# EAGLE schematic Resistor_Resistor (EAGLE 8.3.0), part 36 of 43
## Nets (continued)
N$107: R19601.2 R19602.2 R19603.2 R19604.2 R19605.2 R19606.2 R19607.2 R19608.2 R19609.2 R19610.2 R19611.2 R19612.2 R19613.2 R19614.2 R19615.2 R19616.2 R19617.2 R19618.2 R19619.2 R19620.2 R19621.2 R19622.2 R19623.2 R19624.2 R19625.2 R19626.2 R19627.2 R19628.2 R19629.2 R19630.2 R19631.2 R19632.2 R19633.2 R19634.2 R19635.2 R19636.2 R19637.2 R19638.2 R19639.2 R19640.2 R19641.2 R19642.2 R19643.2 R19644.2 R19645.2 R19646.2 R19647.2 R19648.2 R19649.2 R19650.2 R19651.2 R19652.2 R19653.2 R19654.2 R19655.2 R19656.2 R19657.2 R19658.2 R19659.2 R19660.2 R19661.2 R19662.2 R19663.2 R19664.2 R19665.2 R19666.2 R19667.2 R19668.2 R19669.2 R19670.2 R19671.2 R19672.2 R19673.2 R19674.2 R19675.2 R19676.2 R19677.2 R19678.2 R19679.2 R19680.2 R19681.2 R19682.2 R19683.2 R19684.2 R19685.2 R19686.2 R19687.2 R19688.2 R19689.2 R19690.2 R19691.2 R19692.2 R19693.2 R19694.2 R19695.2 R19696.2 R19697.2 R19698.2 R19699.2 R19700.2 R19701.2 R19702.2 R19703.2 R19704.2 R19705.2 R19706.2 R19707.2 R19708.2 R19709.2 R19710.2 R19711.2 R19712.2 R19713.2 R19714.2 R19715.2 R19716.2 R19717.2 R19718.2 R19719.2 R19720.2 R19721.2 R19722.2 R19723.2 R19724.2 R19725.2 R19726.2 R19727.2 R19728.2 R19729.2 R19730.2 R19731.2 R19732.2 R19733.2 R19734.2 R19735.2 R19736.2 R19737.2 R19738.2 R19739.2 R19740.2 R19741.2 R19742.2 R19743.2 R19744.2 R19745.2 R19746.2 R19747.2 R19748.2 R19749.2 R19750.2 R19751.2 R19752.2 R19753.2 R19754.2 R19755.2 R19756.2 R19757.2 R19758.2 R19759.2 R19760.2 R19761.2 R19762.2 R19763.2 R19764.2 R19765.2 R19766.2 R19767.2 R19768.2 R19769.2 R19770.2 R19771.2 R19772.2 R19773.2 R19774.2 R19775.2 R19776.2 R19777.2 R19778.2 R19779.2 R19780.2 R19781.2 R19782.2 R19783.2 R19784.2 R19785.2 R19786.2 R19787.2 R19788.2 R19789.2 R19790.2 R19791.2 R19792.2 R19793.2 R19794.2 R19795.2 R19796.2 R19797.2 R19798.2 R19799.2 R19800.2 R19801.1 R19802.1 R19803.1 R19804.1 R19805.1 R19806.1 R19807.1 R19808.1 R19809.1 R19810.1 R19811.1 R19812.1 R19813.1 R19814.1 R19815.1 R19816.1 R19817.1 R19818.1 R19819.1 R19820.1 R19821.1 R19822.1 R19823.1 R19824.1 R19825.1 R19826.1 R19827.1 R19828.1 R19829.1 R19830.1 R19831.1 R19832.1 R19833.1 R19834.1 R19835.1 R19836.1 R19837.1 R19838.1 R19839.1 R19840.1 R19841.1 R19842.1 R19843.1 R19844.1 R19845.1 R19846.1 R19847.1 R19848.1 R19849.1 R19850.1 R19851.1 R19852.1 R19853.1 R19854.1 R19855.1 R19856.1 R19857.1 R19858.1 R19859.1 R19860.1 R19861.1 R19862.1 R19863.1 R19864.1 R19865.1 R19866.1 R19867.1 R19868.1 R19869.1 R19870.1 R19871.1 R19872.1 R19873.1 R19874.1 R19875.1 R19876.1 R19877.1 R19878.1 R19879.1 R19880.1 R19881.1 R19882.1 R19883.1 R19884.1 R19885.1 R19886.1 R19887.1 R19888.1 R19889.1 R19890.1 R19891.1 R19892.1 R19893.1 R19894.1 R19895.1 R19896.1 R19897.1 R19898.1 R19899.1 R19900.1 R19901.1 R19902.1 R19903.1 R19904.1 R19905.1 R19906.1 R19907.1 R19908.1 R19909.1 R19910.1 R19911.1 R19912.1 R19913.1 R19914.1 R19915.1 R19916.1 R19917.1 R19918.1 R19919.1 R19920.1 R19921.1 R19922.1 R19923.1 R19924.1 R19925.1 R19926.1 R19927.1 R19928.1 R19929.1 R19930.1 R19931.1 R19932.1 R19933.1 R19934.1 R19935.1 R19936.1 R19937.1 R19938.1 R19939.1 R19940.1 R19941.1 R19942.1 R19943.1 R19944.1 R19945.1 R19946.1 R19947.1 R19948.1 R19949.1 R19950.1 R19951.1 R19952.1 R19953.1 R19954.1 R19955.1 R19956.1 R19957.1 R19958.1 R19959.1 R19960.1 R19961.1 R19962.1 R19963.1 R19964.1 R19965.1 R19966.1 R19967.1 R19968.1 R19969.1 R19970.1 R19971.1 R19972.1 R19973.1 R19974.1 R19975.1 R19976.1 R19977.1 R19978.1 R19979.1 R19980.1 R19981.1 R19982.1 R19983.1 R19984.1 R19985.1 R19986.1 R19987.1 R19988.1 R19989.1 R19990.1 R19991.1 R19992.1 R19993.1 R19994.1 R19995.1 R19996.1 R19997.1 R19998.1 R19999.1 R20000.1
N$108: R19801.2 R19802.2 R19803.2 R19804.2 R19805.2 R19806.2 R19807.2 R19808.2 R19809.2 R19810.2 R19811.2 R19812.2 R19813.2 R19814.2 R19815.2 R19816.2 R19817.2 R19818.2 R19819.2 R19820.2 R19821.2 R19822.2 R19823.2 R19824.2 R19825.2 R19826.2 R19827.2 R19828.2 R19829.2 R19830.2 R19831.2 R19832.2 R19833.2 R19834.2 R19835.2 R19836.2 R19837.2 R19838.2 R19839.2 R19840.2 R19841.2 R19842.2 R19843.2 R19844.2 R19845.2 R19846.2 R19847.2 R19848.2 R19849.2 R19850.2 R19851.2 R19852.2 R19853.2 R19854.2 R19855.2 R19856.2 R19857.2 R19858.2 R19859.2 R19860.2 R19861.2 R19862.2 R19863.2 R19864.2 R19865.2 R19866.2 R19867.2 R19868.2 R19869.2 R19870.2 R19871.2 R19872.2 R19873.2 R19874.2 R19875.2 R19876.2 R19877.2 R19878.2 R19879.2 R19880.2 R19881.2 R19882.2 R19883.2 R19884.2 R19885.2 R19886.2 R19887.2 R19888.2 R19889.2 R19890.2 R19891.2 R19892.2 R19893.2 R19894.2 R19895.2 R19896.2 R19897.2 R19898.2 R19899.2 R19900.2 R19901.2 R19902.2 R19903.2 R19904.2 R19905.2 R19906.2 R19907.2 R19908.2 R19909.2 R19910.2 R19911.2 R19912.2 R19913.2 R19914.2 R19915.2 R19916.2 R19917.2 R19918.2 R19919.2 R19920.2 R19921.2 R19922.2 R19923.2 R19924.2 R19925.2 R19926.2 R19927.2 R19928.2 R19929.2 R19930.2 R19931.2 R19932.2 R19933.2 R19934.2 R19935.2 R19936.2 R19937.2 R19938.2 R19939.2 R19940.2 R19941.2 R19942.2 R19943.2 R19944.2 R19945.2 R19946.2 R19947.2 R19948.2 R19949.2 R19950.2 R19951.2 R19952.2 R19953.2 R19954.2 R19955.2 R19956.2 R19957.2 R19958.2 R19959.2 R19960.2 R19961.2 R19962.2 R19963.2 R19964.2 R19965.2 R19966.2 R19967.2 R19968.2 R19969.2 R19970.2 R19971.2 R19972.2 R19973.2 R19974.2 R19975.2 R19976.2 R19977.2 R19978.2 R19979.2 R19980.2 R19981.2 R19982.2 R19983.2 R19984.2 R19985.2 R19986.2 R19987.2 R19988.2 R19989.2 R19990.2 R19991.2 R19992.2 R19993.2 R19994.2 R19995.2 R19996.2 R19997.2 R19998.2 R19999.2 R20000.2 R20001.1 R20002.1 R20003.1 R20004.1 R20005.1 R20006.1 R20007.1 R20008.1 R20009.1 R20010.1 R20011.1 R20012.1 R20013.1 R20014.1 R20015.1 R20016.1 R20017.1 R20018.1 R20019.1 R20020.1 R20021.1 R20022.1 R20023.1 R20024.1 R20025.1 R20026.1 R20027.1 R20028.1 R20029.1 R20030.1 R20031.1 R20032.1 R20033.1 R20034.1 R20035.1 R20036.1 R20037.1 R20038.1 R20039.1 R20040.1 R20041.1 R20042.1 R20043.1 R20044.1 R20045.1 R20046.1 R20047.1 R20048.1 R20049.1 R20050.1 R20051.1 R20052.1 R20053.1 R20054.1 R20055.1 R20056.1 R20057.1 R20058.1 R20059.1 R20060.1 R20061.1 R20062.1 R20063.1 R20064.1 R20065.1 R20066.1 R20067.1 R20068.1 R20069.1 R20070.1 R20071.1 R20072.1 R20073.1 R20074.1 R20075.1 R20076.1 R20077.1 R20078.1 R20079.1 R20080.1 R20081.1 R20082.1 R20083.1 R20084.1 R20085.1 R20086.1 R20087.1 R20088.1 R20089.1 R20090.1 R20091.1 R20092.1 R20093.1 R20094.1 R20095.1 R20096.1 R20097.1 R20098.1 R20099.1 R20100.1 R20101.1 R20102.1 R20103.1 R20104.1 R20105.1 R20106.1 R20107.1 R20108.1 R20109.1 R20110.1 R20111.1 R20112.1 R20113.1 R20114.1 R20115.1 R20116.1 R20117.1 R20118.1 R20119.1 R20120.1 R20121.1 R20122.1 R20123.1 R20124.1 R20125.1 R20126.1 R20127.1 R20128.1 R20129.1 R20130.1 R20131.1 R20132.1 R20133.1 R20134.1 R20135.1 R20136.1 R20137.1 R20138.1 R20139.1 R20140.1 R20141.1 R20142.1 R20143.1 R20144.1 R20145.1 R20146.1 R20147.1 R20148.1 R20149.1 R20150.1 R20151.1 R20152.1 R20153.1 R20154.1 R20155.1 R20156.1 R20157.1 R20158.1 R20159.1 R20160.1 R20161.1 R20162.1 R20163.1 R20164.1 R20165.1 R20166.1 R20167.1 R20168.1 R20169.1 R20170.1 R20171.1 R20172.1 R20173.1 R20174.1 R20175.1 R20176.1 R20177.1 R20178.1 R20179.1 R20180.1 R20181.1 R20182.1 R20183.1 R20184.1 R20185.1 R20186.1 R20187.1 R20188.1 R20189.1 R20190.1 R20191.1 R20192.1 R20193.1 R20194.1 R20195.1 R20196.1 R20197.1 R20198.1 R20199.1 R20200.1
N$109: R20001.2 R20002.2 R20003.2 R20004.2 R20005.2 R20006.2 R20007.2 R20008.2 R20009.2 R20010.2 R20011.2 R20012.2 R20013.2 R20014.2 R20015.2 R20016.2 R20017.2 R20018.2 R20019.2 R20020.2 R20021.2 R20022.2 R20023.2 R20024.2 R20025.2 R20026.2 R20027.2 R20028.2 R20029.2 R20030.2 R20031.2 R20032.2 R20033.2 R20034.2 R20035.2 R20036.2 R20037.2 R20038.2 R20039.2 R20040.2 R20041.2 R20042.2 R20043.2 R20044.2 R20045.2 R20046.2 R20047.2 R20048.2 R20049.2 R20050.2 R20051.2 R20052.2 R20053.2 R20054.2 R20055.2 R20056.2 R20057.2 R20058.2 R20059.2 R20060.2 R20061.2 R20062.2 R20063.2 R20064.2 R20065.2 R20066.2 R20067.2 R20068.2 R20069.2 R20070.2 R20071.2 R20072.2 R20073.2 R20074.2 R20075.2 R20076.2 R20077.2 R20078.2 R20079.2 R20080.2 R20081.2 R20082.2 R20083.2 R20084.2 R20085.2 R20086.2 R20087.2 R20088.2 R20089.2 R20090.2 R20091.2 R20092.2 R20093.2 R20094.2 R20095.2 R20096.2 R20097.2 R20098.2 R20099.2 R20100.2 R20101.2 R20102.2 R20103.2 R20104.2 R20105.2 R20106.2 R20107.2 R20108.2 R20109.2 R20110.2 R20111.2 R20112.2 R20113.2 R20114.2 R20115.2 R20116.2 R20117.2 R20118.2 R20119.2 R20120.2 R20121.2 R20122.2 R20123.2 R20124.2 R20125.2 R20126.2 R20127.2 R20128.2 R20129.2 R20130.2 R20131.2 R20132.2 R20133.2 R20134.2 R20135.2 R20136.2 R20137.2 R20138.2 R20139.2 R20140.2 R20141.2 R20142.2 R20143.2 R20144.2 R20145.2 R20146.2 R20147.2 R20148.2 R20149.2 R20150.2 R20151.2 R20152.2 R20153.2 R20154.2 R20155.2 R20156.2 R20157.2 R20158.2 R20159.2 R20160.2 R20161.2 R20162.2 R20163.2 R20164.2 R20165.2 R20166.2 R20167.2 R20168.2 R20169.2 R20170.2 R20171.2 R20172.2 R20173.2 R20174.2 R20175.2 R20176.2 R20177.2 R20178.2 R20179.2 R20180.2 R20181.2 R20182.2 R20183.2 R20184.2 R20185.2 R20186.2 R20187.2 R20188.2 R20189.2 R20190.2 R20191.2 R20192.2 R20193.2 R20194.2 R20195.2 R20196.2 R20197.2 R20198.2 R20199.2 R20200.2 R20201.1 R20202.1 R20203.1 R20204.1 R20205.1 R20206.1 R20207.1 R20208.1 R20209.1 R20210.1 R20211.1 R20212.1 R20213.1 R20214.1 R20215.1 R20216.1 R20217.1 R20218.1 R20219.1 R20220.1 R20221.1 R20222.1 R20223.1 R20224.1 R20225.1 R20226.1 R20227.1 R20228.1 R20229.1 R20230.1 R20231.1 R20232.1 R20233.1 R20234.1 R20235.1 R20236.1 R20237.1 R20238.1 R20239.1 R20240.1 R20241.1 R20242.1 R20243.1 R20244.1 R20245.1 R20246.1 R20247.1 R20248.1 R20249.1 R20250.1 R20251.1 R20252.1 R20253.1 R20254.1 R20255.1 R20256.1 R20257.1 R20258.1 R20259.1 R20260.1 R20261.1 R20262.1 R20263.1 R20264.1 R20265.1 R20266.1 R20267.1 R20268.1 R20269.1 R20270.1 R20271.1 R20272.1 R20273.1 R20274.1 R20275.1 R20276.1 R20277.1 R20278.1 R20279.1 R20280.1 R20281.1 R20282.1 R20283.1 R20284.1 R20285.1 R20286.1 R20287.1 R20288.1 R20289.1 R20290.1 R20291.1 R20292.1 R20293.1 R20294.1 R20295.1 R20296.1 R20297.1 R20298.1 R20299.1 R20300.1 R20301.1 R20302.1 R20303.1 R20304.1 R20305.1 R20306.1 R20307.1 R20308.1 R20309.1 R20310.1 R20311.1 R20312.1 R20313.1 R20314.1 R20315.1 R20316.1 R20317.1 R20318.1 R20319.1 R20320.1 R20321.1 R20322.1 R20323.1 R20324.1 R20325.1 R20326.1 R20327.1 R20328.1 R20329.1 R20330.1 R20331.1 R20332.1 R20333.1 R20334.1 R20335.1 R20336.1 R20337.1 R20338.1 R20339.1 R20340.1 R20341.1 R20342.1 R20343.1 R20344.1 R20345.1 R20346.1 R20347.1 R20348.1 R20349.1 R20350.1 R20351.1 R20352.1 R20353.1 R20354.1 R20355.1 R20356.1 R20357.1 R20358.1 R20359.1 R20360.1 R20361.1 R20362.1 R20363.1 R20364.1 R20365.1 R20366.1 R20367.1 R20368.1 R20369.1 R20370.1 R20371.1 R20372.1 R20373.1 R20374.1 R20375.1 R20376.1 R20377.1 R20378.1 R20379.1 R20380.1 R20381.1 R20382.1 R20383.1 R20384.1 R20385.1 R20386.1 R20387.1 R20388.1 R20389.1 R20390.1 R20391.1 R20392.1 R20393.1 R20394.1 R20395.1 R20396.1 R20397.1 R20398.1 R20399.1 R20400.1
N$110: R20201.2 R20202.2 R20203.2 R20204.2 R20205.2 R20206.2 R20207.2 R20208.2 R20209.2 R20210.2 R20211.2 R20212.2 R20213.2 R20214.2 R20215.2 R20216.2 R20217.2 R20218.2 R20219.2 R20220.2 R20221.2 R20222.2 R20223.2 R20224.2 R20225.2 R20226.2 R20227.2 R20228.2 R20229.2 R20230.2 R20231.2 R20232.2 R20233.2 R20234.2 R20235.2 R20236.2 R20237.2 R20238.2 R20239.2 R20240.2 R20241.2 R20242.2 R20243.2 R20244.2 R20245.2 R20246.2 R20247.2 R20248.2 R20249.2 R20250.2 R20251.2 R20252.2 R20253.2 R20254.2 R20255.2 R20256.2 R20257.2 R20258.2 R20259.2 R20260.2 R20261.2 R20262.2 R20263.2 R20264.2 R20265.2 R20266.2 R20267.2 R20268.2 R20269.2 R20270.2 R20271.2 R20272.2 R20273.2 R20274.2 R20275.2 R20276.2 R20277.2 R20278.2 R20279.2 R20280.2 R20281.2 R20282.2 R20283.2 R20284.2 R20285.2 R20286.2 R20287.2 R20288.2 R20289.2 R20290.2 R20291.2 R20292.2 R20293.2 R20294.2 R20295.2 R20296.2 R20297.2 R20298.2 R20299.2 R20300.2 R20301.2 R20302.2 R20303.2 R20304.2 R20305.2 R20306.2 R20307.2 R20308.2 R20309.2 R20310.2 R20311.2 R20312.2 R20313.2 R20314.2 R20315.2 R20316.2 R20317.2 R20318.2 R20319.2 R20320.2 R20321.2 R20322.2 R20323.2 R20324.2 R20325.2 R20326.2 R20327.2 R20328.2 R20329.2 R20330.2 R20331.2 R20332.2 R20333.2 R20334.2 R20335.2 R20336.2 R20337.2 R20338.2 R20339.2 R20340.2 R20341.2 R20342.2 R20343.2 R20344.2 R20345.2 R20346.2 R20347.2 R20348.2 R20349.2 R20350.2 R20351.2 R20352.2 R20353.2 R20354.2 R20355.2 R20356.2 R20357.2 R20358.2 R20359.2 R20360.2 R20361.2 R20362.2 R20363.2 R20364.2 R20365.2 R20366.2 R20367.2 R20368.2 R20369.2 R20370.2 R20371.2 R20372.2 R20373.2 R20374.2 R20375.2 R20376.2 R20377.2 R20378.2 R20379.2 R20380.2 R20381.2 R20382.2 R20383.2 R20384.2 R20385.2 R20386.2 R20387.2 R20388.2 R20389.2 R20390.2 R20391.2 R20392.2 R20393.2 R20394.2 R20395.2 R20396.2 R20397.2 R20398.2 R20399.2 R20400.2 R20401.1 R20402.1 R20403.1 R20404.1 R20405.1 R20406.1 R20407.1 R20408.1 R20409.1 R20410.1 R20411.1 R20412.1 R20413.1 R20414.1 R20415.1 R20416.1 R20417.1 R20418.1 R20419.1 R20420.1 R20421.1 R20422.1 R20423.1 R20424.1 R20425.1 R20426.1 R20427.1 R20428.1 R20429.1 R20430.1 R20431.1 R20432.1 R20433.1 R20434.1 R20435.1 R20436.1 R20437.1 R20438.1 R20439.1 R20440.1 R20441.1 R20442.1 R20443.1 R20444.1 R20445.1 R20446.1 R20447.1 R20448.1 R20449.1 R20450.1 R20451.1 R20452.1 R20453.1 R20454.1 R20455.1 R20456.1 R20457.1 R20458.1 R20459.1 R20460.1 R20461.1 R20462.1 R20463.1 R20464.1 R20465.1 R20466.1 R20467.1 R20468.1 R20469.1 R20470.1 R20471.1 R20472.1 R20473.1 R20474.1 R20475.1 R20476.1 R20477.1 R20478.1 R20479.1 R20480.1 R20481.1 R20482.1 R20483.1 R20484.1 R20485.1 R20486.1 R20487.1 R20488.1 R20489.1 R20490.1 R20491.1 R20492.1 R20493.1 R20494.1 R20495.1 R20496.1 R20497.1 R20498.1 R20499.1 R20500.1 R20501.1 R20502.1 R20503.1 R20504.1 R20505.1 R20506.1 R20507.1 R20508.1 R20509.1 R20510.1 R20511.1 R20512.1 R20513.1 R20514.1 R20515.1 R20516.1 R20517.1 R20518.1 R20519.1 R20520.1 R20521.1 R20522.1 R20523.1 R20524.1 R20525.1 R20526.1 R20527.1 R20528.1 R20529.1 R20530.1 R20531.1 R20532.1 R20533.1 R20534.1 R20535.1 R20536.1 R20537.1 R20538.1 R20539.1 R20540.1 R20541.1 R20542.1 R20543.1 R20544.1 R20545.1 R20546.1 R20547.1 R20548.1 R20549.1 R20550.1 R20551.1 R20552.1 R20553.1 R20554.1 R20555.1 R20556.1 R20557.1 R20558.1 R20559.1 R20560.1 R20561.1 R20562.1 R20563.1 R20564.1 R20565.1 R20566.1 R20567.1 R20568.1 R20569.1 R20570.1 R20571.1 R20572.1 R20573.1 R20574.1 R20575.1 R20576.1 R20577.1 R20578.1 R20579.1 R20580.1 R20581.1 R20582.1 R20583.1 R20584.1 R20585.1 R20586.1 R20587.1 R20588.1 R20589.1 R20590.1 R20591.1 R20592.1 R20593.1 R20594.1 R20595.1 R20596.1 R20597.1 R20598.1 R20599.1 R20600.1
N$111: R20401.2 R20402.2 R20403.2 R20404.2 R20405.2 R20406.2 R20407.2 R20408.2 R20409.2 R20410.2 R20411.2 R20412.2 R20413.2 R20414.2 R20415.2 R20416.2 R20417.2 R20418.2 R20419.2 R20420.2 R20421.2 R20422.2 R20423.2 R20424.2 R20425.2 R20426.2 R20427.2 R20428.2 R20429.2 R20430.2 R20431.2 R20432.2 R20433.2 R20434.2 R20435.2 R20436.2 R20437.2 R20438.2 R20439.2 R20440.2 R20441.2 R20442.2 R20443.2 R20444.2 R20445.2 R20446.2 R20447.2 R20448.2 R20449.2 R20450.2 R20451.2 R20452.2 R20453.2 R20454.2 R20455.2 R20456.2 R20457.2 R20458.2 R20459.2 R20460.2 R20461.2 R20462.2 R20463.2 R20464.2 R20465.2 R20466.2 R20467.2 R20468.2 R20469.2 R20470.2 R20471.2 R20472.2 R20473.2 R20474.2 R20475.2 R20476.2 R20477.2 R20478.2 R20479.2 R20480.2 R20481.2 R20482.2 R20483.2 R20484.2 R20485.2 R20486.2 R20487.2 R20488.2 R20489.2 R20490.2 R20491.2 R20492.2 R20493.2 R20494.2 R20495.2 R20496.2 R20497.2 R20498.2 R20499.2 R20500.2 R20501.2 R20502.2 R20503.2 R20504.2 R20505.2 R20506.2 R20507.2 R20508.2 R20509.2 R20510.2 R20511.2 R20512.2 R20513.2 R20514.2 R20515.2 R20516.2 R20517.2 R20518.2 R20519.2 R20520.2 R20521.2 R20522.2 R20523.2 R20524.2 R20525.2 R20526.2 R20527.2 R20528.2 R20529.2 R20530.2 R20531.2 R20532.2 R20533.2 R20534.2 R20535.2 R20536.2 R20537.2 R20538.2 R20539.2 R20540.2 R20541.2 R20542.2 R20543.2 R20544.2 R20545.2 R20546.2 R20547.2 R20548.2 R20549.2 R20550.2 R20551.2 R20552.2 R20553.2 R20554.2 R20555.2 R20556.2 R20557.2 R20558.2 R20559.2 R20560.2 R20561.2 R20562.2 R20563.2 R20564.2 R20565.2 R20566.2 R20567.2 R20568.2 R20569.2 R20570.2 R20571.2 R20572.2 R20573.2 R20574.2 R20575.2 R20576.2 R20577.2 R20578.2 R20579.2 R20580.2 R20581.2 R20582.2 R20583.2 R20584.2 R20585.2 R20586.2 R20587.2 R20588.2 R20589.2 R20590.2 R20591.2 R20592.2 R20593.2 R20594.2 R20595.2 R20596.2 R20597.2 R20598.2 R20599.2 R20600.2 R20601.1 R20602.1 R20603.1 R20604.1 R20605.1 R20606.1 R20607.1 R20608.1 R20609.1 R20610.1 R20611.1 R20612.1 R20613.1 R20614.1 R20615.1 R20616.1 R20617.1 R20618.1 R20619.1 R20620.1 R20621.1 R20622.1 R20623.1 R20624.1 R20625.1 R20626.1 R20627.1 R20628.1 R20629.1 R20630.1 R20631.1 R20632.1 R20633.1 R20634.1 R20635.1 R20636.1 R20637.1 R20638.1 R20639.1 R20640.1 R20641.1 R20642.1 R20643.1 R20644.1 R20645.1 R20646.1 R20647.1 R20648.1 R20649.1 R20650.1 R20651.1 R20652.1 R20653.1 R20654.1 R20655.1 R20656.1 R20657.1 R20658.1 R20659.1 R20660.1 R20661.1 R20662.1 R20663.1 R20664.1 R20665.1 R20666.1 R20667.1 R20668.1 R20669.1 R20670.1 R20671.1 R20672.1 R20673.1 R20674.1 R20675.1 R20676.1 R20677.1 R20678.1 R20679.1 R20680.1 R20681.1 R20682.1 R20683.1 R20684.1 R20685.1 R20686.1 R20687.1 R20688.1 R20689.1 R20690.1 R20691.1 R20692.1 R20693.1 R20694.1 R20695.1 R20696.1 R20697.1 R20698.1 R20699.1 R20700.1 R20701.1 R20702.1 R20703.1 R20704.1 R20705.1 R20706.1 R20707.1 R20708.1 R20709.1 R20710.1 R20711.1 R20712.1 R20713.1 R20714.1 R20715.1 R20716.1 R20717.1 R20718.1 R20719.1 R20720.1 R20721.1 R20722.1 R20723.1 R20724.1 R20725.1 R20726.1 R20727.1 R20728.1 R20729.1 R20730.1 R20731.1 R20732.1 R20733.1 R20734.1 R20735.1 R20736.1 R20737.1 R20738.1 R20739.1 R20740.1 R20741.1 R20742.1 R20743.1 R20744.1 R20745.1 R20746.1 R20747.1 R20748.1 R20749.1 R20750.1 R20751.1 R20752.1 R20753.1 R20754.1 R20755.1 R20756.1 R20757.1 R20758.1 R20759.1 R20760.1 R20761.1 R20762.1 R20763.1 R20764.1 R20765.1 R20766.1 R20767.1 R20768.1 R20769.1 R20770.1 R20771.1 R20772.1 R20773.1 R20774.1 R20775.1 R20776.1 R20777.1 R20778.1 R20779.1 R20780.1 R20781.1 R20782.1 R20783.1 R20784.1 R20785.1 R20786.1 R20787.1 R20788.1 R20789.1 R20790.1 R20791.1 R20792.1 R20793.1 R20794.1 R20795.1 R20796.1 R20797.1 R20798.1 R20799.1 R20800.1
N$112: R20601.2 R20602.2 R20603.2 R20604.2 R20605.2 R20606.2 R20607.2 R20608.2 R20609.2 R20610.2 R20611.2 R20612.2 R20613.2 R20614.2 R20615.2 R20616.2 R20617.2 R20618.2 R20619.2 R20620.2 R20621.2 R20622.2 R20623.2 R20624.2 R20625.2 R20626.2 R20627.2 R20628.2 R20629.2 R20630.2 R20631.2 R20632.2 R20633.2 R20634.2 R20635.2 R20636.2 R20637.2 R20638.2 R20639.2 R20640.2 R20641.2 R20642.2 R20643.2 R20644.2 R20645.2 R20646.2 R20647.2 R20648.2 R20649.2 R20650.2 R20651.2 R20652.2 R20653.2 R20654.2 R20655.2 R20656.2 R20657.2 R20658.2 R20659.2 R20660.2 R20661.2 R20662.2 R20663.2 R20664.2 R20665.2 R20666.2 R20667.2 R20668.2 R20669.2 R20670.2 R20671.2 R20672.2 R20673.2 R20674.2 R20675.2 R20676.2 R20677.2 R20678.2 R20679.2 R20680.2 R20681.2 R20682.2 R20683.2 R20684.2 R20685.2 R20686.2 R20687.2 R20688.2 R20689.2 R20690.2 R20691.2 R20692.2 R20693.2 R20694.2 R20695.2 R20696.2 R20697.2 R20698.2 R20699.2 R20700.2 R20701.2 R20702.2 R20703.2 R20704.2 R20705.2 R20706.2 R20707.2 R20708.2 R20709.2 R20710.2 R20711.2 R20712.2 R20713.2 R20714.2 R20715.2 R20716.2 R20717.2 R20718.2 R20719.2 R20720.2 R20721.2 R20722.2 R20723.2 R20724.2 R20725.2 R20726.2 R20727.2 R20728.2 R20729.2 R20730.2 R20731.2 R20732.2 R20733.2 R20734.2 R20735.2 R20736.2 R20737.2 R20738.2 R20739.2 R20740.2 R20741.2 R20742.2 R20743.2 R20744.2 R20745.2 R20746.2 R20747.2 R20748.2 R20749.2 R20750.2 R20751.2 R20752.2 R20753.2 R20754.2 R20755.2 R20756.2 R20757.2 R20758.2 R20759.2 R20760.2 R20761.2 R20762.2 R20763.2 R20764.2 R20765.2 R20766.2 R20767.2 R20768.2 R20769.2 R20770.2 R20771.2 R20772.2 R20773.2 R20774.2 R20775.2 R20776.2 R20777.2 R20778.2 R20779.2 R20780.2 R20781.2 R20782.2 R20783.2 R20784.2 R20785.2 R20786.2 R20787.2 R20788.2 R20789.2 R20790.2 R20791.2 R20792.2 R20793.2 R20794.2 R20795.2 R20796.2 R20797.2 R20798.2 R20799.2 R20800.2 R20801.1 R20802.1 R20803.1 R20804.1 R20805.1 R20806.1 R20807.1 R20808.1 R20809.1 R20810.1 R20811.1 R20812.1 R20813.1 R20814.1 R20815.1 R20816.1 R20817.1 R20818.1 R20819.1 R20820.1 R20821.1 R20822.1 R20823.1 R20824.1 R20825.1 R20826.1 R20827.1 R20828.1 R20829.1 R20830.1 R20831.1 R20832.1 R20833.1 R20834.1 R20835.1 R20836.1 R20837.1 R20838.1 R20839.1 R20840.1 R20841.1 R20842.1 R20843.1 R20844.1 R20845.1 R20846.1 R20847.1 R20848.1 R20849.1 R20850.1 R20851.1 R20852.1 R20853.1 R20854.1 R20855.1 R20856.1 R20857.1 R20858.1 R20859.1 R20860.1 R20861.1 R20862.1 R20863.1 R20864.1 R20865.1 R20866.1 R20867.1 R20868.1 R20869.1 R20870.1 R20871.1 R20872.1 R20873.1 R20874.1 R20875.1 R20876.1 R20877.1 R20878.1 R20879.1 R20880.1 R20881.1 R20882.1 R20883.1 R20884.1 R20885.1 R20886.1 R20887.1 R20888.1 R20889.1 R20890.1 R20891.1 R20892.1 R20893.1 R20894.1 R20895.1 R20896.1 R20897.1 R20898.1 R20899.1 R20900.1 R20901.1 R20902.1 R20903.1 R20904.1 R20905.1 R20906.1 R20907.1 R20908.1 R20909.1 R20910.1 R20911.1 R20912.1 R20913.1 R20914.1 R20915.1 R20916.1 R20917.1 R20918.1 R20919.1 R20920.1 R20921.1 R20922.1 R20923.1 R20924.1 R20925.1 R20926.1 R20927.1 R20928.1 R20929.1 R20930.1 R20931.1 R20932.1 R20933.1 R20934.1 R20935.1 R20936.1 R20937.1 R20938.1 R20939.1 R20940.1 R20941.1 R20942.1 R20943.1 R20944.1 R20945.1 R20946.1 R20947.1 R20948.1 R20949.1 R20950.1 R20951.1 R20952.1 R20953.1 R20954.1 R20955.1 R20956.1 R20957.1 R20958.1 R20959.1 R20960.1 R20961.1 R20962.1 R20963.1 R20964.1 R20965.1 R20966.1 R20967.1 R20968.1 R20969.1 R20970.1 R20971.1 R20972.1 R20973.1 R20974.1 R20975.1 R20976.1 R20977.1 R20978.1 R20979.1 R20980.1 R20981.1 R20982.1 R20983.1 R20984.1 R20985.1 R20986.1 R20987.1 R20988.1 R20989.1 R20990.1 R20991.1 R20992.1 R20993.1 R20994.1 R20995.1 R20996.1 R20997.1 R20998.1 R20999.1 R21000.1
N$113: R20801.2 R20802.2 R20803.2 R20804.2 R20805.2 R20806.2 R20807.2 R20808.2 R20809.2 R20810.2 R20811.2 R20812.2 R20813.2 R20814.2 R20815.2 R20816.2 R20817.2 R20818.2 R20819.2 R20820.2 R20821.2 R20822.2 R20823.2 R20824.2 R20825.2 R20826.2 R20827.2 R20828.2 R20829.2 R20830.2 R20831.2 R20832.2 R20833.2 R20834.2 R20835.2 R20836.2 R20837.2 R20838.2 R20839.2 R20840.2 R20841.2 R20842.2 R20843.2 R20844.2 R20845.2 R20846.2 R20847.2 R20848.2 R20849.2 R20850.2 R20851.2 R20852.2 R20853.2 R20854.2 R20855.2 R20856.2 R20857.2 R20858.2 R20859.2 R20860.2 R20861.2 R20862.2 R20863.2 R20864.2 R20865.2 R20866.2 R20867.2 R20868.2 R20869.2 R20870.2 R20871.2 R20872.2 R20873.2 R20874.2 R20875.2 R20876.2 R20877.2 R20878.2 R20879.2 R20880.2 R20881.2 R20882.2 R20883.2 R20884.2 R20885.2 R20886.2 R20887.2 R20888.2 R20889.2 R20890.2 R20891.2 R20892.2 R20893.2 R20894.2 R20895.2 R20896.2 R20897.2 R20898.2 R20899.2 R20900.2 R20901.2 R20902.2 R20903.2 R20904.2 R20905.2 R20906.2 R20907.2 R20908.2 R20909.2 R20910.2 R20911.2 R20912.2 R20913.2 R20914.2 R20915.2 R20916.2 R20917.2 R20918.2 R20919.2 R20920.2 R20921.2 R20922.2 R20923.2 R20924.2 R20925.2 R20926.2 R20927.2 R20928.2 R20929.2 R20930.2 R20931.2 R20932.2 R20933.2 R20934.2 R20935.2 R20936.2 R20937.2 R20938.2 R20939.2 R20940.2 R20941.2 R20942.2 R20943.2 R20944.2 R20945.2 R20946.2 R20947.2 R20948.2 R20949.2 R20950.2 R20951.2 R20952.2 R20953.2 R20954.2 R20955.2 R20956.2 R20957.2 R20958.2 R20959.2 R20960.2 R20961.2 R20962.2 R20963.2 R20964.2 R20965.2 R20966.2 R20967.2 R20968.2 R20969.2 R20970.2 R20971.2 R20972.2 R20973.2 R20974.2 R20975.2 R20976.2 R20977.2 R20978.2 R20979.2 R20980.2 R20981.2 R20982.2 R20983.2 R20984.2 R20985.2 R20986.2 R20987.2 R20988.2 R20989.2 R20990.2 R20991.2 R20992.2 R20993.2 R20994.2 R20995.2 R20996.2 R20997.2 R20998.2 R20999.2 R21000.2 R21001.1 R21002.1 R21003.1 R21004.1 R21005.1 R21006.1 R21007.1 R21008.1 R21009.1 R21010.1 R21011.1 R21012.1 R21013.1 R21014.1 R21015.1 R21016.1 R21017.1 R21018.1 R21019.1 R21020.1 R21021.1 R21022.1 R21023.1 R21024.1 R21025.1 R21026.1 R21027.1 R21028.1 R21029.1 R21030.1 R21031.1 R21032.1 R21033.1 R21034.1 R21035.1 R21036.1 R21037.1 R21038.1 R21039.1 R21040.1 R21041.1 R21042.1 R21043.1 R21044.1 R21045.1 R21046.1 R21047.1 R21048.1 R21049.1 R21050.1 R21051.1 R21052.1 R21053.1 R21054.1 R21055.1 R21056.1 R21057.1 R21058.1 R21059.1 R21060.1 R21061.1 R21062.1 R21063.1 R21064.1 R21065.1 R21066.1 R21067.1 R21068.1 R21069.1 R21070.1 R21071.1 R21072.1 R21073.1 R21074.1 R21075.1 R21076.1 R21077.1 R21078.1 R21079.1 R21080.1 R21081.1 R21082.1 R21083.1 R21084.1 R21085.1 R21086.1 R21087.1 R21088.1 R21089.1 R21090.1 R21091.1 R21092.1 R21093.1 R21094.1 R21095.1 R21096.1 R21097.1 R21098.1 R21099.1 R21100.1 R21101.1 R21102.1 R21103.1 R21104.1 R21105.1 R21106.1 R21107.1 R21108.1 R21109.1 R21110.1 R21111.1 R21112.1 R21113.1 R21114.1 R21115.1 R21116.1 R21117.1 R21118.1 R21119.1 R21120.1 R21121.1 R21122.1 R21123.1 R21124.1 R21125.1 R21126.1 R21127.1 R21128.1 R21129.1 R21130.1 R21131.1 R21132.1 R21133.1 R21134.1 R21135.1 R21136.1 R21137.1 R21138.1 R21139.1 R21140.1 R21141.1 R21142.1 R21143.1 R21144.1 R21145.1 R21146.1 R21147.1 R21148.1 R21149.1 R21150.1 R21151.1 R21152.1 R21153.1 R21154.1 R21155.1 R21156.1 R21157.1 R21158.1 R21159.1 R21160.1 R21161.1 R21162.1 R21163.1 R21164.1 R21165.1 R21166.1 R21167.1 R21168.1 R21169.1 R21170.1 R21171.1 R21172.1 R21173.1 R21174.1 R21175.1 R21176.1 R21177.1 R21178.1 R21179.1 R21180.1 R21181.1 R21182.1 R21183.1 R21184.1 R21185.1 R21186.1 R21187.1 R21188.1 R21189.1 R21190.1 R21191.1 R21192.1 R21193.1 R21194.1 R21195.1 R21196.1 R21197.1 R21198.1 R21199.1 R21200.1
N$114: R21001.2 R21002.2 R21003.2 R21004.2 R21005.2 R21006.2 R21007.2 R21008.2 R21009.2 R21010.2 R21011.2 R21012.2 R21013.2 R21014.2 R21015.2 R21016.2 R21017.2 R21018.2 R21019.2 R21020.2 R21021.2 R21022.2 R21023.2 R21024.2 R21025.2 R21026.2 R21027.2 R21028.2 R21029.2 R21030.2 R21031.2 R21032.2 R21033.2 R21034.2 R21035.2 R21036.2 R21037.2 R21038.2 R21039.2 R21040.2 R21041.2 R21042.2 R21043.2 R21044.2 R21045.2 R21046.2 R21047.2 R21048.2 R21049.2 R21050.2 R21051.2 R21052.2 R21053.2 R21054.2 R21055.2 R21056.2 R21057.2 R21058.2 R21059.2 R21060.2 R21061.2 R21062.2 R21063.2 R21064.2 R21065.2 R21066.2 R21067.2 R21068.2 R21069.2 R21070.2 R21071.2 R21072.2 R21073.2 R21074.2 R21075.2 R21076.2 R21077.2 R21078.2 R21079.2 R21080.2 R21081.2 R21082.2 R21083.2 R21084.2 R21085.2 R21086.2 R21087.2 R21088.2 R21089.2 R21090.2 R21091.2 R21092.2 R21093.2 R21094.2 R21095.2 R21096.2 R21097.2 R21098.2 R21099.2 R21100.2 R21101.2 R21102.2 R21103.2 R21104.2 R21105.2 R21106.2 R21107.2 R21108.2 R21109.2 R21110.2 R21111.2 R21112.2 R21113.2 R21114.2 R21115.2 R21116.2 R21117.2 R21118.2 R21119.2 R21120.2 R21121.2 R21122.2 R21123.2 R21124.2 R21125.2 R21126.2 R21127.2 R21128.2 R21129.2 R21130.2 R21131.2 R21132.2 R21133.2 R21134.2 R21135.2 R21136.2 R21137.2 R21138.2 R21139.2 R21140.2 R21141.2 R21142.2 R21143.2 R21144.2 R21145.2 R21146.2 R21147.2 R21148.2 R21149.2 R21150.2 R21151.2 R21152.2 R21153.2 R21154.2 R21155.2 R21156.2 R21157.2 R21158.2 R21159.2 R21160.2 R21161.2 R21162.2 R21163.2 R21164.2 R21165.2 R21166.2 R21167.2 R21168.2 R21169.2 R21170.2 R21171.2 R21172.2 R21173.2 R21174.2 R21175.2 R21176.2 R21177.2 R21178.2 R21179.2 R21180.2 R21181.2 R21182.2 R21183.2 R21184.2 R21185.2 R21186.2 R21187.2 R21188.2 R21189.2 R21190.2 R21191.2 R21192.2 R21193.2 R21194.2 R21195.2 R21196.2 R21197.2 R21198.2 R21199.2 R21200.2 R21201.1 R21202.1 R21203.1 R21204.1 R21205.1 R21206.1 R21207.1 R21208.1 R21209.1 R21210.1 R21211.1 R21212.1 R21213.1 R21214.1 R21215.1 R21216.1 R21217.1 R21218.1 R21219.1 R21220.1 R21221.1 R21222.1 R21223.1 R21224.1 R21225.1 R21226.1 R21227.1 R21228.1 R21229.1 R21230.1 R21231.1 R21232.1 R21233.1 R21234.1 R21235.1 R21236.1 R21237.1 R21238.1 R21239.1 R21240.1 R21241.1 R21242.1 R21243.1 R21244.1 R21245.1 R21246.1 R21247.1 R21248.1 R21249.1 R21250.1 R21251.1 R21252.1 R21253.1 R21254.1 R21255.1 R21256.1 R21257.1 R21258.1 R21259.1 R21260.1 R21261.1 R21262.1 R21263.1 R21264.1 R21265.1 R21266.1 R21267.1 R21268.1 R21269.1 R21270.1 R21271.1 R21272.1 R21273.1 R21274.1 R21275.1 R21276.1 R21277.1 R21278.1 R21279.1 R21280.1 R21281.1 R21282.1 R21283.1 R21284.1 R21285.1 R21286.1 R21287.1 R21288.1 R21289.1 R21290.1 R21291.1 R21292.1 R21293.1 R21294.1 R21295.1 R21296.1 R21297.1 R21298.1 R21299.1 R21300.1 R21301.1 R21302.1 R21303.1 R21304.1 R21305.1 R21306.1 R21307.1 R21308.1 R21309.1 R21310.1 R21311.1 R21312.1 R21313.1 R21314.1 R21315.1 R21316.1 R21317.1 R21318.1 R21319.1 R21320.1 R21321.1 R21322.1 R21323.1 R21324.1 R21325.1 R21326.1 R21327.1 R21328.1 R21329.1 R21330.1 R21331.1 R21332.1 R21333.1 R21334.1 R21335.1 R21336.1 R21337.1 R21338.1 R21339.1 R21340.1 R21341.1 R21342.1 R21343.1 R21344.1 R21345.1 R21346.1 R21347.1 R21348.1 R21349.1 R21350.1 R21351.1 R21352.1 R21353.1 R21354.1 R21355.1 R21356.1 R21357.1 R21358.1 R21359.1 R21360.1 R21361.1 R21362.1 R21363.1 R21364.1 R21365.1 R21366.1 R21367.1 R21368.1 R21369.1 R21370.1 R21371.1 R21372.1 R21373.1 R21374.1 R21375.1 R21376.1 R21377.1 R21378.1 R21379.1 R21380.1 R21381.1 R21382.1 R21383.1 R21384.1 R21385.1 R21386.1 R21387.1 R21388.1 R21389.1 R21390.1 R21391.1 R21392.1 R21393.1 R21394.1 R21395.1 R21396.1 R21397.1 R21398.1 R21399.1 R21400.1
N$115: R21201.2 R21202.2 R21203.2 R21204.2 R21205.2 R21206.2 R21207.2 R21208.2 R21209.2 R21210.2 R21211.2 R21212.2 R21213.2 R21214.2 R21215.2 R21216.2 R21217.2 R21218.2 R21219.2 R21220.2 R21221.2 R21222.2 R21223.2 R21224.2 R21225.2 R21226.2 R21227.2 R21228.2 R21229.2 R21230.2 R21231.2 R21232.2 R21233.2 R21234.2 R21235.2 R21236.2 R21237.2 R21238.2 R21239.2 R21240.2 R21241.2 R21242.2 R21243.2 R21244.2 R21245.2 R21246.2 R21247.2 R21248.2 R21249.2 R21250.2 R21251.2 R21252.2 R21253.2 R21254.2 R21255.2 R21256.2 R21257.2 R21258.2 R21259.2 R21260.2 R21261.2 R21262.2 R21263.2 R21264.2 R21265.2 R21266.2 R21267.2 R21268.2 R21269.2 R21270.2 R21271.2 R21272.2 R21273.2 R21274.2 R21275.2 R21276.2 R21277.2 R21278.2 R21279.2 R21280.2 R21281.2 R21282.2 R21283.2 R21284.2 R21285.2 R21286.2 R21287.2 R21288.2 R21289.2 R21290.2 R21291.2 R21292.2 R21293.2 R21294.2 R21295.2 R21296.2 R21297.2 R21298.2 R21299.2 R21300.2 R21301.2 R21302.2 R21303.2 R21304.2 R21305.2 R21306.2 R21307.2 R21308.2 R21309.2 R21310.2 R21311.2 R21312.2 R21313.2 R21314.2 R21315.2 R21316.2 R21317.2 R21318.2 R21319.2 R21320.2 R21321.2 R21322.2 R21323.2 R21324.2 R21325.2 R21326.2 R21327.2 R21328.2 R21329.2 R21330.2 R21331.2 R21332.2 R21333.2 R21334.2 R21335.2 R21336.2 R21337.2 R21338.2 R21339.2 R21340.2 R21341.2 R21342.2 R21343.2 R21344.2 R21345.2 R21346.2 R21347.2 R21348.2 R21349.2 R21350.2 R21351.2 R21352.2 R21353.2 R21354.2 R21355.2 R21356.2 R21357.2 R21358.2 R21359.2 R21360.2 R21361.2 R21362.2 R21363.2 R21364.2 R21365.2 R21366.2 R21367.2 R21368.2 R21369.2 R21370.2 R21371.2 R21372.2 R21373.2 R21374.2 R21375.2 R21376.2 R21377.2 R21378.2 R21379.2 R21380.2 R21381.2 R21382.2 R21383.2 R21384.2 R21385.2 R21386.2 R21387.2 R21388.2 R21389.2 R21390.2 R21391.2 R21392.2 R21393.2 R21394.2 R21395.2 R21396.2 R21397.2 R21398.2 R21399.2 R21400.2 R21401.1 R21402.1 R21403.1 R21404.1 R21405.1 R21406.1 R21407.1 R21408.1 R21409.1 R21410.1 R21411.1 R21412.1 R21413.1 R21414.1 R21415.1 R21416.1 R21417.1 R21418.1 R21419.1 R21420.1 R21421.1 R21422.1 R21423.1 R21424.1 R21425.1 R21426.1 R21427.1 R21428.1 R21429.1 R21430.1 R21431.1 R21432.1 R21433.1 R21434.1 R21435.1 R21436.1 R21437.1 R21438.1 R21439.1 R21440.1 R21441.1 R21442.1 R21443.1 R21444.1 R21445.1 R21446.1 R21447.1 R21448.1 R21449.1 R21450.1 R21451.1 R21452.1 R21453.1 R21454.1 R21455.1 R21456.1 R21457.1 R21458.1 R21459.1 R21460.1 R21461.1 R21462.1 R21463.1 R21464.1 R21465.1 R21466.1 R21467.1 R21468.1 R21469.1 R21470.1 R21471.1 R21472.1 R21473.1 R21474.1 R21475.1 R21476.1 R21477.1 R21478.1 R21479.1 R21480.1 R21481.1 R21482.1 R21483.1 R21484.1 R21485.1 R21486.1 R21487.1 R21488.1 R21489.1 R21490.1 R21491.1 R21492.1 R21493.1 R21494.1 R21495.1 R21496.1 R21497.1 R21498.1 R21499.1 R21500.1 R21501.1 R21502.1 R21503.1 R21504.1 R21505.1 R21506.1 R21507.1 R21508.1 R21509.1 R21510.1 R21511.1 R21512.1 R21513.1 R21514.1 R21515.1 R21516.1 R21517.1 R21518.1 R21519.1 R21520.1 R21521.1 R21522.1 R21523.1 R21524.1 R21525.1 R21526.1 R21527.1 R21528.1 R21529.1 R21530.1 R21531.1 R21532.1 R21533.1 R21534.1 R21535.1 R21536.1 R21537.1 R21538.1 R21539.1 R21540.1 R21541.1 R21542.1 R21543.1 R21544.1 R21545.1 R21546.1 R21547.1 R21548.1 R21549.1 R21550.1 R21551.1 R21552.1 R21553.1 R21554.1 R21555.1 R21556.1 R21557.1 R21558.1 R21559.1 R21560.1 R21561.1 R21562.1 R21563.1 R21564.1 R21565.1 R21566.1 R21567.1 R21568.1 R21569.1 R21570.1 R21571.1 R21572.1 R21573.1 R21574.1 R21575.1 R21576.1 R21577.1 R21578.1 R21579.1 R21580.1 R21581.1 R21582.1 R21583.1 R21584.1 R21585.1 R21586.1 R21587.1 R21588.1 R21589.1 R21590.1 R21591.1 R21592.1 R21593.1 R21594.1 R21595.1 R21596.1 R21597.1 R21598.1 R21599.1 R21600.1
N$116: R21401.2 R21402.2 R21403.2 R21404.2 R21405.2 R21406.2 R21407.2 R21408.2 R21409.2 R21410.2 R21411.2 R21412.2 R21413.2 R21414.2 R21415.2 R21416.2 R21417.2 R21418.2 R21419.2 R21420.2 R21421.2 R21422.2 R21423.2 R21424.2 R21425.2 R21426.2 R21427.2 R21428.2 R21429.2 R21430.2 R21431.2 R21432.2 R21433.2 R21434.2 R21435.2 R21436.2 R21437.2 R21438.2 R21439.2 R21440.2 R21441.2 R21442.2 R21443.2 R21444.2 R21445.2 R21446.2 R21447.2 R21448.2 R21449.2 R21450.2 R21451.2 R21452.2 R21453.2 R21454.2 R21455.2 R21456.2 R21457.2 R21458.2 R21459.2 R21460.2 R21461.2 R21462.2 R21463.2 R21464.2 R21465.2 R21466.2 R21467.2 R21468.2 R21469.2 R21470.2 R21471.2 R21472.2 R21473.2 R21474.2 R21475.2 R21476.2 R21477.2 R21478.2 R21479.2 R21480.2 R21481.2 R21482.2 R21483.2 R21484.2 R21485.2 R21486.2 R21487.2 R21488.2 R21489.2 R21490.2 R21491.2 R21492.2 R21493.2 R21494.2 R21495.2 R21496.2 R21497.2 R21498.2 R21499.2 R21500.2 R21501.2 R21502.2 R21503.2 R21504.2 R21505.2 R21506.2 R21507.2 R21508.2 R21509.2 R21510.2 R21511.2 R21512.2 R21513.2 R21514.2 R21515.2 R21516.2 R21517.2 R21518.2 R21519.2 R21520.2 R21521.2 R21522.2 R21523.2 R21524.2 R21525.2 R21526.2 R21527.2 R21528.2 R21529.2 R21530.2 R21531.2 R21532.2 R21533.2 R21534.2 R21535.2 R21536.2 R21537.2 R21538.2 R21539.2 R21540.2 R21541.2 R21542.2 R21543.2 R21544.2 R21545.2 R21546.2 R21547.2 R21548.2 R21549.2 R21550.2 R21551.2 R21552.2 R21553.2 R21554.2 R21555.2 R21556.2 R21557.2 R21558.2 R21559.2 R21560.2 R21561.2 R21562.2 R21563.2 R21564.2 R21565.2 R21566.2 R21567.2 R21568.2 R21569.2 R21570.2 R21571.2 R21572.2 R21573.2 R21574.2 R21575.2 R21576.2 R21577.2 R21578.2 R21579.2 R21580.2 R21581.2 R21582.2 R21583.2 R21584.2 R21585.2 R21586.2 R21587.2 R21588.2 R21589.2 R21590.2 R21591.2 R21592.2 R21593.2 R21594.2 R21595.2 R21596.2 R21597.2 R21598.2 R21599.2 R21600.2 R21601.1 R21602.1 R21603.1 R21604.1 R21605.1 R21606.1 R21607.1 R21608.1 R21609.1 R21610.1 R21611.1 R21612.1 R21613.1 R21614.1 R21615.1 R21616.1 R21617.1 R21618.1 R21619.1 R21620.1 R21621.1 R21622.1 R21623.1 R21624.1 R21625.1 R21626.1 R21627.1 R21628.1 R21629.1 R21630.1 R21631.1 R21632.1 R21633.1 R21634.1 R21635.1 R21636.1 R21637.1 R21638.1 R21639.1 R21640.1 R21641.1 R21642.1 R21643.1 R21644.1 R21645.1 R21646.1 R21647.1 R21648.1 R21649.1 R21650.1 R21651.1 R21652.1 R21653.1 R21654.1 R21655.1 R21656.1 R21657.1 R21658.1 R21659.1 R21660.1 R21661.1 R21662.1 R21663.1 R21664.1 R21665.1 R21666.1 R21667.1 R21668.1 R21669.1 R21670.1 R21671.1 R21672.1 R21673.1 R21674.1 R21675.1 R21676.1 R21677.1 R21678.1 R21679.1 R21680.1 R21681.1 R21682.1 R21683.1 R21684.1 R21685.1 R21686.1 R21687.1 R21688.1 R21689.1 R21690.1 R21691.1 R21692.1 R21693.1 R21694.1 R21695.1 R21696.1 R21697.1 R21698.1 R21699.1 R21700.1 R21701.1 R21702.1 R21703.1 R21704.1 R21705.1 R21706.1 R21707.1 R21708.1 R21709.1 R21710.1 R21711.1 R21712.1 R21713.1 R21714.1 R21715.1 R21716.1 R21717.1 R21718.1 R21719.1 R21720.1 R21721.1 R21722.1 R21723.1 R21724.1 R21725.1 R21726.1 R21727.1 R21728.1 R21729.1 R21730.1 R21731.1 R21732.1 R21733.1 R21734.1 R21735.1 R21736.1 R21737.1 R21738.1 R21739.1 R21740.1 R21741.1 R21742.1 R21743.1 R21744.1 R21745.1 R21746.1 R21747.1 R21748.1 R21749.1 R21750.1 R21751.1 R21752.1 R21753.1 R21754.1 R21755.1 R21756.1 R21757.1 R21758.1 R21759.1 R21760.1 R21761.1 R21762.1 R21763.1 R21764.1 R21765.1 R21766.1 R21767.1 R21768.1 R21769.1 R21770.1 R21771.1 R21772.1 R21773.1 R21774.1 R21775.1 R21776.1 R21777.1 R21778.1 R21779.1 R21780.1 R21781.1 R21782.1 R21783.1 R21784.1 R21785.1 R21786.1 R21787.1 R21788.1 R21789.1 R21790.1 R21791.1 R21792.1 R21793.1 R21794.1 R21795.1 R21796.1 R21797.1 R21798.1 R21799.1 R21800.1
N$117: R21601.2 R21602.2 R21603.2 R21604.2 R21605.2 R21606.2 R21607.2 R21608.2 R21609.2 R21610.2 R21611.2 R21612.2 R21613.2 R21614.2 R21615.2 R21616.2 R21617.2 R21618.2 R21619.2 R21620.2 R21621.2 R21622.2 R21623.2 R21624.2 R21625.2 R21626.2 R21627.2 R21628.2 R21629.2 R21630.2 R21631.2 R21632.2 R21633.2 R21634.2 R21635.2 R21636.2 R21637.2 R21638.2 R21639.2 R21640.2 R21641.2 R21642.2 R21643.2 R21644.2 R21645.2 R21646.2 R21647.2 R21648.2 R21649.2 R21650.2 R21651.2 R21652.2 R21653.2 R21654.2 R21655.2 R21656.2 R21657.2 R21658.2 R21659.2 R21660.2 R21661.2 R21662.2 R21663.2 R21664.2 R21665.2 R21666.2 R21667.2 R21668.2 R21669.2 R21670.2 R21671.2 R21672.2 R21673.2 R21674.2 R21675.2 R21676.2 R21677.2 R21678.2 R21679.2 R21680.2 R21681.2 R21682.2 R21683.2 R21684.2 R21685.2 R21686.2 R21687.2 R21688.2 R21689.2 R21690.2 R21691.2 R21692.2 R21693.2 R21694.2 R21695.2 R21696.2 R21697.2 R21698.2 R21699.2 R21700.2 R21701.2 R21702.2 R21703.2 R21704.2 R21705.2 R21706.2 R21707.2 R21708.2 R21709.2 R21710.2 R21711.2 R21712.2 R21713.2 R21714.2 R21715.2 R21716.2 R21717.2 R21718.2 R21719.2 R21720.2 R21721.2 R21722.2 R21723.2 R21724.2 R21725.2 R21726.2 R21727.2 R21728.2 R21729.2 R21730.2 R21731.2 R21732.2 R21733.2 R21734.2 R21735.2 R21736.2 R21737.2 R21738.2 R21739.2 R21740.2 R21741.2 R21742.2 R21743.2 R21744.2 R21745.2 R21746.2 R21747.2 R21748.2 R21749.2 R21750.2 R21751.2 R21752.2 R21753.2 R21754.2 R21755.2 R21756.2 R21757.2 R21758.2 R21759.2 R21760.2 R21761.2 R21762.2 R21763.2 R21764.2 R21765.2 R21766.2 R21767.2 R21768.2 R21769.2 R21770.2 R21771.2 R21772.2 R21773.2 R21774.2 R21775.2 R21776.2 R21777.2 R21778.2 R21779.2 R21780.2 R21781.2 R21782.2 R21783.2 R21784.2 R21785.2 R21786.2 R21787.2 R21788.2 R21789.2 R21790.2 R21791.2 R21792.2 R21793.2 R21794.2 R21795.2 R21796.2 R21797.2 R21798.2 R21799.2 R21800.2 R21801.1 R21802.1 R21803.1 R21804.1 R21805.1 R21806.1 R21807.1 R21808.1 R21809.1 R21810.1 R21811.1 R21812.1 R21813.1 R21814.1 R21815.1 R21816.1 R21817.1 R21818.1 R21819.1 R21820.1 R21821.1 R21822.1 R21823.1 R21824.1 R21825.1 R21826.1 R21827.1 R21828.1 R21829.1 R21830.1 R21831.1 R21832.1 R21833.1 R21834.1 R21835.1 R21836.1 R21837.1 R21838.1 R21839.1 R21840.1 R21841.1 R21842.1 R21843.1 R21844.1 R21845.1 R21846.1 R21847.1 R21848.1 R21849.1 R21850.1 R21851.1 R21852.1 R21853.1 R21854.1 R21855.1 R21856.1 R21857.1 R21858.1 R21859.1 R21860.1 R21861.1 R21862.1 R21863.1 R21864.1 R21865.1 R21866.1 R21867.1 R21868.1 R21869.1 R21870.1 R21871.1 R21872.1 R21873.1 R21874.1 R21875.1 R21876.1 R21877.1 R21878.1 R21879.1 R21880.1 R21881.1 R21882.1 R21883.1 R21884.1 R21885.1 R21886.1 R21887.1 R21888.1 R21889.1 R21890.1 R21891.1 R21892.1 R21893.1 R21894.1 R21895.1 R21896.1 R21897.1 R21898.1 R21899.1 R21900.1 R21901.1 R21902.1 R21903.1 R21904.1 R21905.1 R21906.1 R21907.1 R21908.1 R21909.1 R21910.1 R21911.1 R21912.1 R21913.1 R21914.1 R21915.1 R21916.1 R21917.1 R21918.1 R21919.1 R21920.1 R21921.1 R21922.1 R21923.1 R21924.1 R21925.1 R21926.1 R21927.1 R21928.1 R21929.1 R21930.1 R21931.1 R21932.1 R21933.1 R21934.1 R21935.1 R21936.1 R21937.1 R21938.1 R21939.1 R21940.1 R21941.1 R21942.1 R21943.1 R21944.1 R21945.1 R21946.1 R21947.1 R21948.1 R21949.1 R21950.1 R21951.1 R21952.1 R21953.1 R21954.1 R21955.1 R21956.1 R21957.1 R21958.1 R21959.1 R21960.1 R21961.1 R21962.1 R21963.1 R21964.1 R21965.1 R21966.1 R21967.1 R21968.1 R21969.1 R21970.1 R21971.1 R21972.1 R21973.1 R21974.1 R21975.1 R21976.1 R21977.1 R21978.1 R21979.1 R21980.1 R21981.1 R21982.1 R21983.1 R21984.1 R21985.1 R21986.1 R21987.1 R21988.1 R21989.1 R21990.1 R21991.1 R21992.1 R21993.1 R21994.1 R21995.1 R21996.1 R21997.1 R21998.1 R21999.1 R22000.1
N$118: R21801.2 R21802.2 R21803.2 R21804.2 R21805.2 R21806.2 R21807.2 R21808.2 R21809.2 R21810.2 R21811.2 R21812.2 R21813.2 R21814.2 R21815.2 R21816.2 R21817.2 R21818.2 R21819.2 R21820.2 R21821.2 R21822.2 R21823.2 R21824.2 R21825.2 R21826.2 R21827.2 R21828.2 R21829.2 R21830.2 R21831.2 R21832.2 R21833.2 R21834.2 R21835.2 R21836.2 R21837.2 R21838.2 R21839.2 R21840.2 R21841.2 R21842.2 R21843.2 R21844.2 R21845.2 R21846.2 R21847.2 R21848.2 R21849.2 R21850.2 R21851.2 R21852.2 R21853.2 R21854.2 R21855.2 R21856.2 R21857.2 R21858.2 R21859.2 R21860.2 R21861.2 R21862.2 R21863.2 R21864.2 R21865.2 R21866.2 R21867.2 R21868.2 R21869.2 R21870.2 R21871.2 R21872.2 R21873.2 R21874.2 R21875.2 R21876.2 R21877.2 R21878.2 R21879.2 R21880.2 R21881.2 R21882.2 R21883.2 R21884.2 R21885.2 R21886.2 R21887.2 R21888.2 R21889.2 R21890.2 R21891.2 R21892.2 R21893.2 R21894.2 R21895.2 R21896.2 R21897.2 R21898.2 R21899.2 R21900.2 R21901.2 R21902.2 R21903.2 R21904.2 R21905.2 R21906.2 R21907.2 R21908.2 R21909.2 R21910.2 R21911.2 R21912.2 R21913.2 R21914.2 R21915.2 R21916.2 R21917.2 R21918.2 R21919.2 R21920.2 R21921.2 R21922.2 R21923.2 R21924.2 R21925.2 R21926.2 R21927.2 R21928.2 R21929.2 R21930.2 R21931.2 R21932.2 R21933.2 R21934.2 R21935.2 R21936.2 R21937.2 R21938.2 R21939.2 R21940.2 R21941.2 R21942.2 R21943.2 R21944.2 R21945.2 R21946.2 R21947.2 R21948.2 R21949.2 R21950.2 R21951.2 R21952.2 R21953.2 R21954.2 R21955.2 R21956.2 R21957.2 R21958.2 R21959.2 R21960.2 R21961.2 R21962.2 R21963.2 R21964.2 R21965.2 R21966.2 R21967.2 R21968.2 R21969.2 R21970.2 R21971.2 R21972.2 R21973.2 R21974.2 R21975.2 R21976.2 R21977.2 R21978.2 R21979.2 R21980.2 R21981.2 R21982.2 R21983.2 R21984.2 R21985.2 R21986.2 R21987.2 R21988.2 R21989.2 R21990.2 R21991.2 R21992.2 R21993.2 R21994.2 R21995.2 R21996.2 R21997.2 R21998.2 R21999.2 R22000.2 R22001.1 R22002.1 R22003.1 R22004.1 R22005.1 R22006.1 R22007.1 R22008.1 R22009.1 R22010.1 R22011.1 R22012.1 R22013.1 R22014.1 R22015.1 R22016.1 R22017.1 R22018.1 R22019.1 R22020.1 R22021.1 R22022.1 R22023.1 R22024.1 R22025.1 R22026.1 R22027.1 R22028.1 R22029.1 R22030.1 R22031.1 R22032.1 R22033.1 R22034.1 R22035.1 R22036.1 R22037.1 R22038.1 R22039.1 R22040.1 R22041.1 R22042.1 R22043.1 R22044.1 R22045.1 R22046.1 R22047.1 R22048.1 R22049.1 R22050.1 R22051.1 R22052.1 R22053.1 R22054.1 R22055.1 R22056.1 R22057.1 R22058.1 R22059.1 R22060.1 R22061.1 R22062.1 R22063.1 R22064.1 R22065.1 R22066.1 R22067.1 R22068.1 R22069.1 R22070.1 R22071.1 R22072.1 R22073.1 R22074.1 R22075.1 R22076.1 R22077.1 R22078.1 R22079.1 R22080.1 R22081.1 R22082.1 R22083.1 R22084.1 R22085.1 R22086.1 R22087.1 R22088.1 R22089.1 R22090.1 R22091.1 R22092.1 R22093.1 R22094.1 R22095.1 R22096.1 R22097.1 R22098.1 R22099.1 R22100.1 R22101.1 R22102.1 R22103.1 R22104.1 R22105.1 R22106.1 R22107.1 R22108.1 R22109.1 R22110.1 R22111.1 R22112.1 R22113.1 R22114.1 R22115.1 R22116.1 R22117.1 R22118.1 R22119.1 R22120.1 R22121.1 R22122.1 R22123.1 R22124.1 R22125.1 R22126.1 R22127.1 R22128.1 R22129.1 R22130.1 R22131.1 R22132.1 R22133.1 R22134.1 R22135.1 R22136.1 R22137.1 R22138.1 R22139.1 R22140.1 R22141.1 R22142.1 R22143.1 R22144.1 R22145.1 R22146.1 R22147.1 R22148.1 R22149.1 R22150.1 R22151.1 R22152.1 R22153.1 R22154.1 R22155.1 R22156.1 R22157.1 R22158.1 R22159.1 R22160.1 R22161.1 R22162.1 R22163.1 R22164.1 R22165.1 R22166.1 R22167.1 R22168.1 R22169.1 R22170.1 R22171.1 R22172.1 R22173.1 R22174.1 R22175.1 R22176.1 R22177.1 R22178.1 R22179.1 R22180.1 R22181.1 R22182.1 R22183.1 R22184.1 R22185.1 R22186.1 R22187.1 R22188.1 R22189.1 R22190.1 R22191.1 R22192.1 R22193.1 R22194.1 R22195.1 R22196.1 R22197.1 R22198.1 R22199.1 R22200.1
N$119: R22001.2 R22002.2 R22003.2 R22004.2 R22005.2 R22006.2 R22007.2 R22008.2 R22009.2 R22010.2 R22011.2 R22012.2 R22013.2 R22014.2 R22015.2 R22016.2 R22017.2 R22018.2 R22019.2 R22020.2 R22021.2 R22022.2 R22023.2 R22024.2 R22025.2 R22026.2 R22027.2 R22028.2 R22029.2 R22030.2 R22031.2 R22032.2 R22033.2 R22034.2 R22035.2 R22036.2 R22037.2 R22038.2 R22039.2 R22040.2 R22041.2 R22042.2 R22043.2 R22044.2 R22045.2 R22046.2 R22047.2 R22048.2 R22049.2 R22050.2 R22051.2 R22052.2 R22053.2 R22054.2 R22055.2 R22056.2 R22057.2 R22058.2 R22059.2 R22060.2 R22061.2 R22062.2 R22063.2 R22064.2 R22065.2 R22066.2 R22067.2 R22068.2 R22069.2 R22070.2 R22071.2 R22072.2 R22073.2 R22074.2 R22075.2 R22076.2 R22077.2 R22078.2 R22079.2 R22080.2 R22081.2 R22082.2 R22083.2 R22084.2 R22085.2 R22086.2 R22087.2 R22088.2 R22089.2 R22090.2 R22091.2 R22092.2 R22093.2 R22094.2 R22095.2 R22096.2 R22097.2 R22098.2 R22099.2 R22100.2 R22101.2 R22102.2 R22103.2 R22104.2 R22105.2 R22106.2 R22107.2 R22108.2 R22109.2 R22110.2 R22111.2 R22112.2 R22113.2 R22114.2 R22115.2 R22116.2 R22117.2 R22118.2 R22119.2 R22120.2 R22121.2 R22122.2 R22123.2 R22124.2 R22125.2 R22126.2 R22127.2 R22128.2 R22129.2 R22130.2 R22131.2 R22132.2 R22133.2 R22134.2 R22135.2 R22136.2 R22137.2 R22138.2 R22139.2 R22140.2 R22141.2 R22142.2 R22143.2 R22144.2 R22145.2 R22146.2 R22147.2 R22148.2 R22149.2 R22150.2 R22151.2 R22152.2 R22153.2 R22154.2 R22155.2 R22156.2 R22157.2 R22158.2 R22159.2 R22160.2 R22161.2 R22162.2 R22163.2 R22164.2 R22165.2 R22166.2 R22167.2 R22168.2 R22169.2 R22170.2 R22171.2 R22172.2 R22173.2 R22174.2 R22175.2 R22176.2 R22177.2 R22178.2 R22179.2 R22180.2 R22181.2 R22182.2 R22183.2 R22184.2 R22185.2 R22186.2 R22187.2 R22188.2 R22189.2 R22190.2 R22191.2 R22192.2 R22193.2 R22194.2 R22195.2 R22196.2 R22197.2 R22198.2 R22199.2 R22200.2 R22201.1 R22202.1 R22203.1 R22204.1 R22205.1 R22206.1 R22207.1 R22208.1 R22209.1 R22210.1 R22211.1 R22212.1 R22213.1 R22214.1 R22215.1 R22216.1 R22217.1 R22218.1 R22219.1 R22220.1 R22221.1 R22222.1 R22223.1 R22224.1 R22225.1 R22226.1 R22227.1 R22228.1 R22229.1 R22230.1 R22231.1 R22232.1 R22233.1 R22234.1 R22235.1 R22236.1 R22237.1 R22238.1 R22239.1 R22240.1 R22241.1 R22242.1 R22243.1 R22244.1 R22245.1 R22246.1 R22247.1 R22248.1 R22249.1 R22250.1 R22251.1 R22252.1 R22253.1 R22254.1 R22255.1 R22256.1 R22257.1 R22258.1 R22259.1 R22260.1 R22261.1 R22262.1 R22263.1 R22264.1 R22265.1 R22266.1 R22267.1 R22268.1 R22269.1 R22270.1 R22271.1 R22272.1 R22273.1 R22274.1 R22275.1 R22276.1 R22277.1 R22278.1 R22279.1 R22280.1 R22281.1 R22282.1 R22283.1 R22284.1 R22285.1 R22286.1 R22287.1 R22288.1 R22289.1 R22290.1 R22291.1 R22292.1 R22293.1 R22294.1 R22295.1 R22296.1 R22297.1 R22298.1 R22299.1 R22300.1 R22301.1 R22302.1 R22303.1 R22304.1 R22305.1 R22306.1 R22307.1 R22308.1 R22309.1 R22310.1 R22311.1 R22312.1 R22313.1 R22314.1 R22315.1 R22316.1 R22317.1 R22318.1 R22319.1 R22320.1 R22321.1 R22322.1 R22323.1 R22324.1 R22325.1 R22326.1 R22327.1 R22328.1 R22329.1 R22330.1 R22331.1 R22332.1 R22333.1 R22334.1 R22335.1 R22336.1 R22337.1 R22338.1 R22339.1 R22340.1 R22341.1 R22342.1 R22343.1 R22344.1 R22345.1 R22346.1 R22347.1 R22348.1 R22349.1 R22350.1 R22351.1 R22352.1 R22353.1 R22354.1 R22355.1 R22356.1 R22357.1 R22358.1 R22359.1 R22360.1 R22361.1 R22362.1 R22363.1 R22364.1 R22365.1 R22366.1 R22367.1 R22368.1 R22369.1 R22370.1 R22371.1 R22372.1 R22373.1 R22374.1 R22375.1 R22376.1 R22377.1 R22378.1 R22379.1 R22380.1 R22381.1 R22382.1 R22383.1 R22384.1 R22385.1 R22386.1 R22387.1 R22388.1 R22389.1 R22390.1 R22391.1 R22392.1 R22393.1 R22394.1 R22395.1 R22396.1 R22397.1 R22398.1 R22399.1 R22400.1